# EasyEDA Pro project kuafu01_030内部老化方案_4.eprj, board PCB4 (continued)
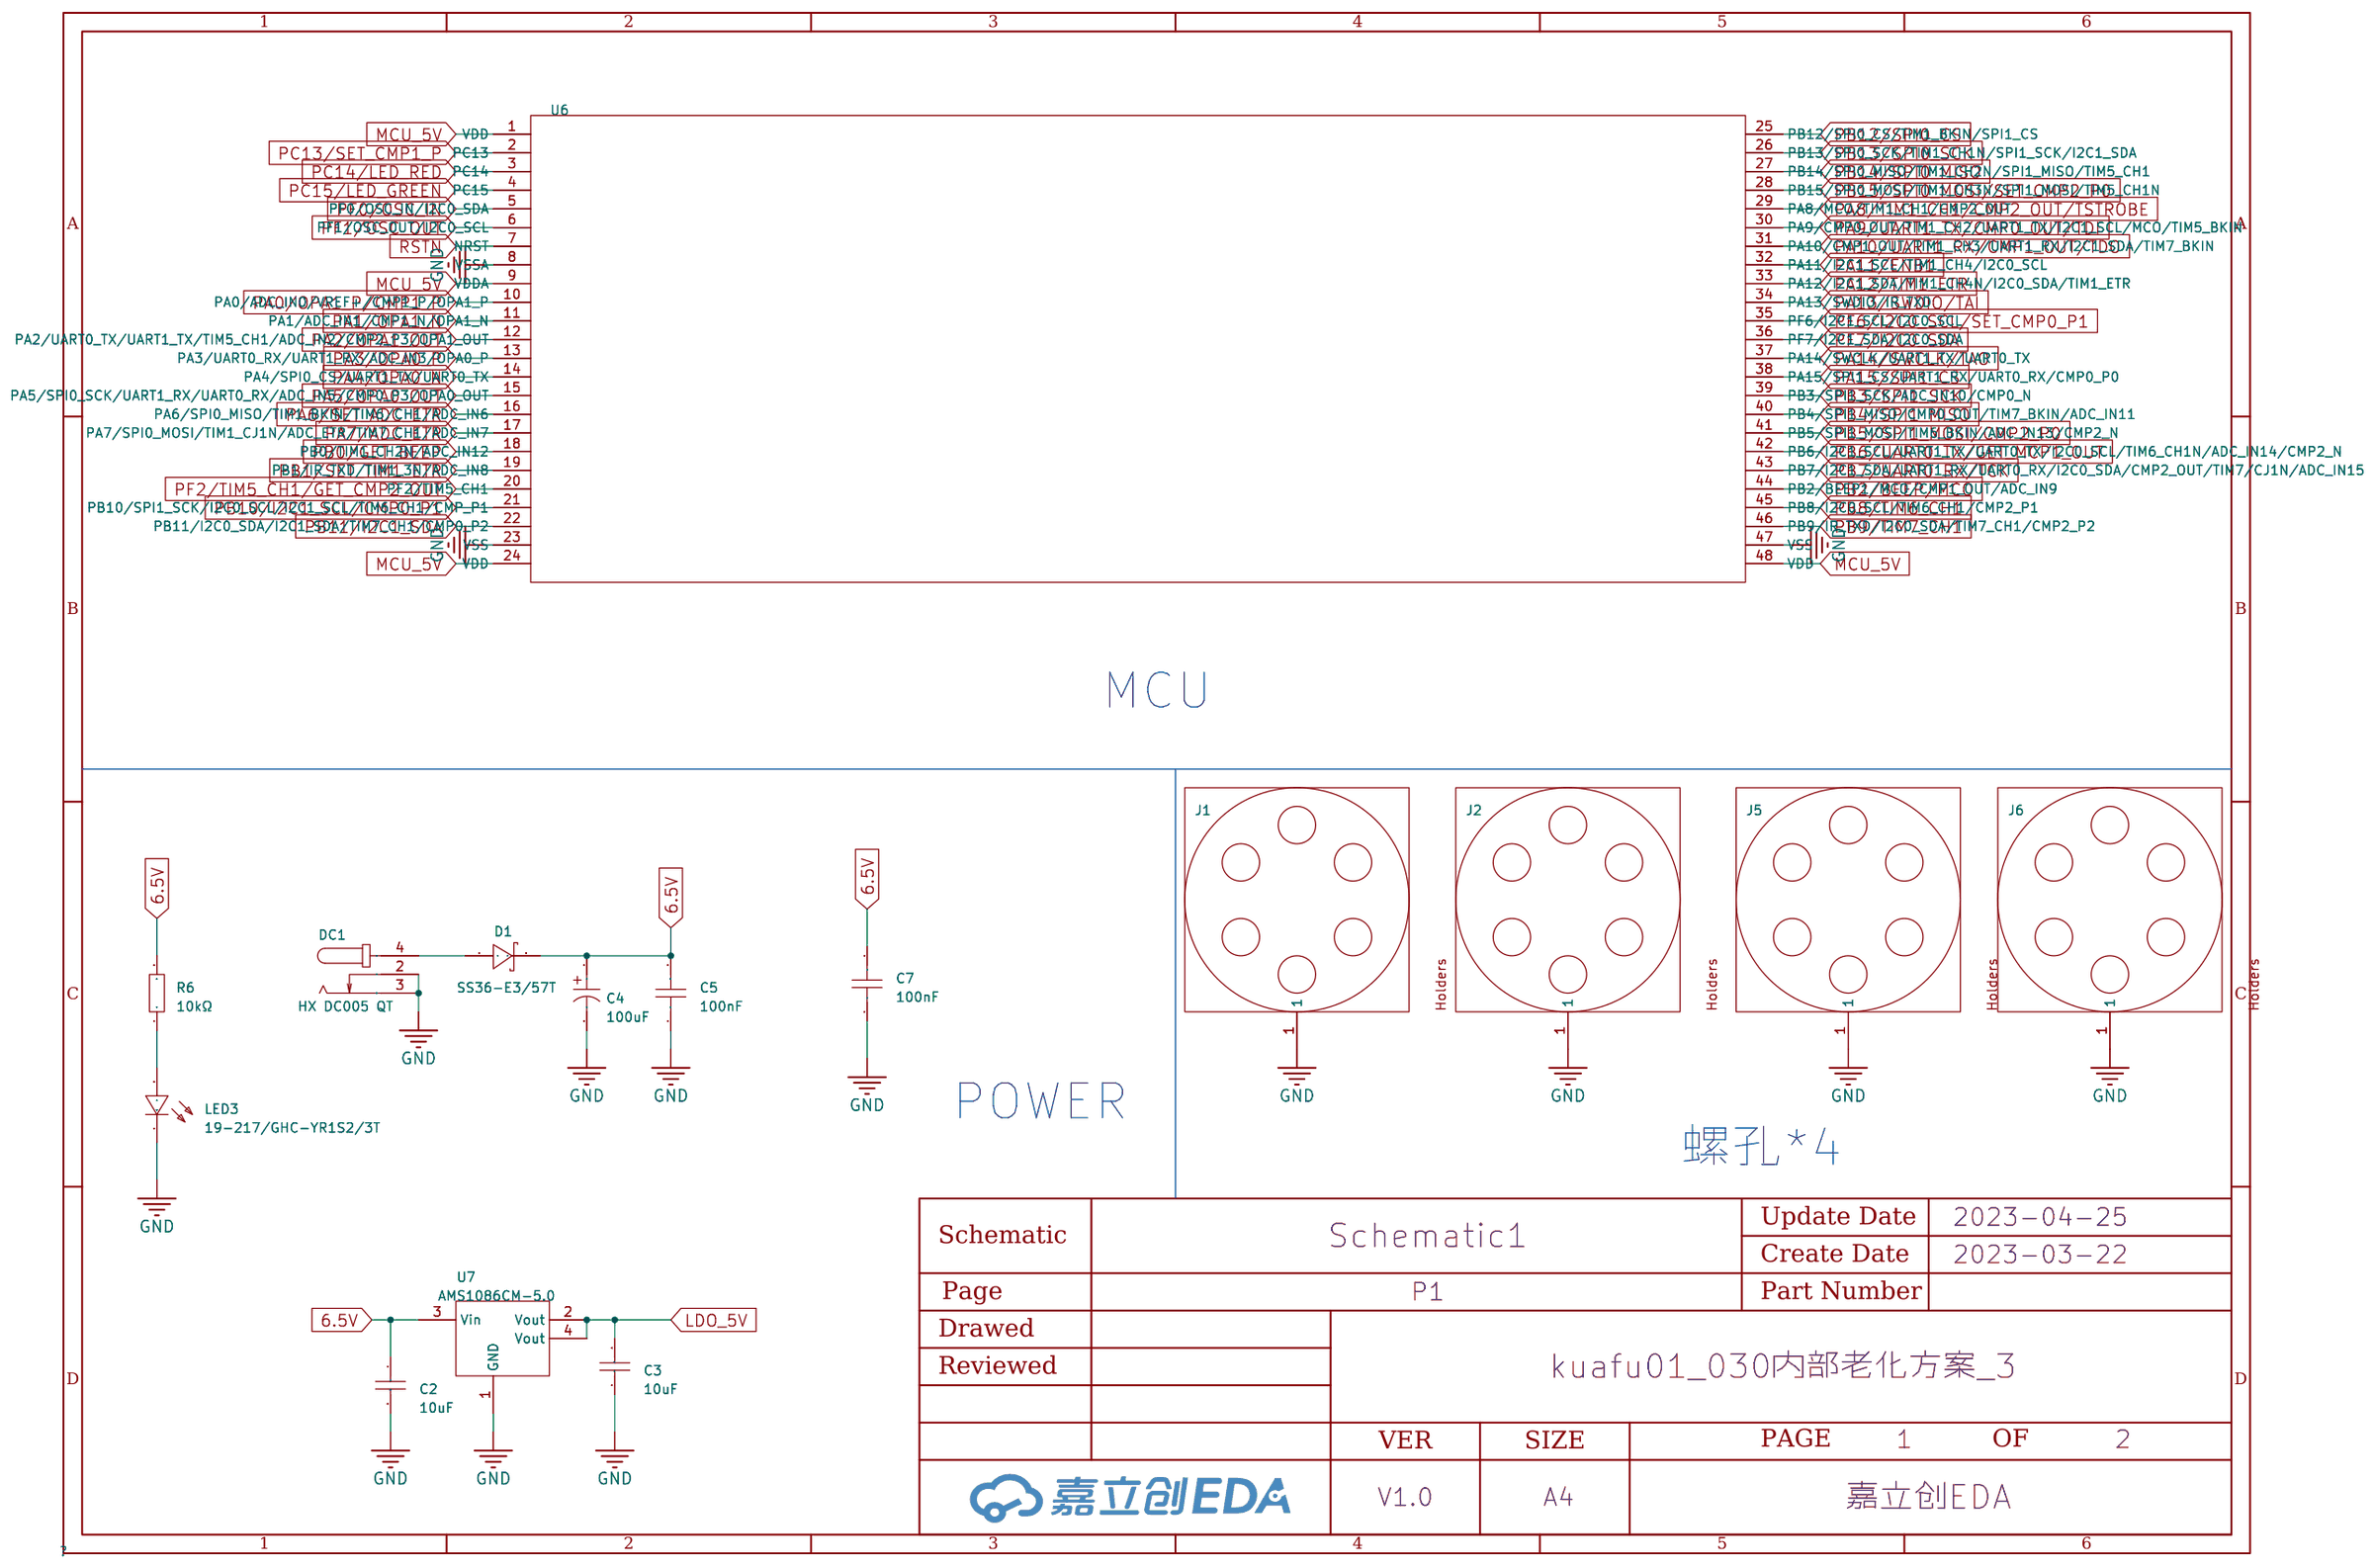
[diagram p0: P1]
## Routing (per net, layer and track width the routed paths; a pad name or vN(x,y) marks a point on that pad's centre or on a via; arc(x,y) is an arc through that point) (continued)
  vias: v1(44.45,259.08) v1(44.45,258.08) v1(44.45,257.08) v1(44.47,253.48) v1(44.47,252.48) v1(44.47,251.48) v1(44.97,140.95) v1(44.97,139.95) v1(44.97,138.95) v1(45.23,184.64) v1(45.23,183.64) v1(45.23,182.64) v1(45.2,179.05) v1(45.2,178.05) v1(45.2,177.05) v1(45.23,147.05) v1(45.23,146.05) v1(45.23,145.05) v1(45.45,259.08) v1(45.45,258.08) v1(45.45,257.08) v1(45.47,253.48) v1(45.47,252.48) v1(45.47,251.48) v1(45.48,64.75) v1(45.48,63.75) v1(45.48,62.75) v1(45.74,102.6) v1(45.74,101.6) v1(45.74,100.6) v1(45.74,70.6) v1(45.74,69.6) v1(45.74,68.6) v1(45.97,140.95) v1(45.97,139.95) v1(45.97,138.95) v1(46.23,184.64) v1(46.23,183.64) v1(46.23,182.64) v1(46.2,179.05) v1(46.2,178.05) v1(46.2,177.05) v1(46.23,147.05) v1(46.23,146.05) v1(46.23,145.05) v1(46.24,31.99) v1(46.24,30.99) v1(46.24,29.99) v1(46.45,259.08) v1(46.45,258.08) v1(46.45,257.08) v1(46.47,253.48) v1(46.47,252.48) v1(46.47,251.48) v1(46.48,64.75) v1(46.48,63.75) v1(46.48,62.75) v1(46.74,102.6) v1(46.74,101.6) v1(46.74,100.6) v1(46.74,70.6) v1(46.74,69.6) v1(46.74,68.6) v1(46.97,140.95) v1(46.97,139.95) v1(46.97,138.95) v1(47.01,222.23) v1(47.01,221.23) v1(47.01,220.23) v1(47.01,216.65) v1(47.01,215.65) v1(47.01,214.65) v1(47.23,184.64) v1(47.23,183.64) v1(47.23,182.64) v1(47.2,179.05) v1(47.2,178.05) v1(47.2,177.05) v1(47.23,147.05) v1(47.23,146.05) v1(47.23,145.05) v1(47.24,31.99) v1(47.24,30.99) v1(47.24,29.99) v1(47.48,64.75) v1(47.48,63.75) v1(47.48,62.75) v1(47.74,102.6) v1(47.74,101.6) v1(47.74,100.6) v1(47.74,70.6) v1(47.74,69.6) v1(47.74,68.6) v1(48.01,222.23) v1(48.01,221.23) v1(48.01,220.23) v1(48.01,216.65) v1(48.01,215.65) v1(48.01,214.65) v1(48.28,108.95) v1(48.28,107.95) v1(48.28,106.95) v1(48.24,31.99) v1(48.24,30.99) v1(48.24,29.99) v1(49.01,222.23) v1(49.01,221.23) v1(49.01,220.23) v1(49.01,216.65) v1(49.01,215.65) v1(49.01,214.65) v1(49.28,108.95) v1(49.28,107.95) v1(49.28,106.95) v1(49.29,147.05) v1(49.29,146.05) v1(49.29,145.05) v1(49.29,141.21) v1(49.29,140.21) v1(49.29,139.21) v1(50.28,108.95) v1(50.28,107.95) v1(50.28,106.95) v1(50.31,184.64) v1(50.31,183.64) v1(50.31,182.64) v1(50.31,179.05) v1(50.31,178.05) v1(50.31,177.05) v1(50.29,147.05) v1(50.29,146.05) v1(50.29,145.05) v1(50.29,141.21) v1(50.29,140.21) v1(50.29,139.21) v1(51.31,184.64) v1(51.31,183.64) v1(51.31,182.64) v1(51.31,179.05) v1(51.31,178.05) v1(51.31,177.05) v1(51.29,147.05) v1(51.29,146.05) v1(51.29,145.05) v1(51.29,141.21) v1(51.29,140.21) v1(51.29,139.21) v1(51.83,259.06) v1(51.83,258.06) v1(51.83,257.06) v1(51.83,253.98) v1(51.83,252.98) v1(51.83,251.98) v1(52.34,222.23) v1(52.34,221.23) v1(52.34,220.23) v1(52.34,216.65) v1(52.34,215.65) v1(52.34,214.65) v1(52.31,184.64) v1(52.31,183.64) v1(52.31,182.64) v1(52.31,179.05) v1(52.31,178.05) v1(52.31,177.05) v1(52.83,259.06) v1(52.83,258.06) v1(52.83,257.06) v1(52.83,253.98) v1(52.83,252.98) v1(52.83,251.98) v1(52.85,70.6) v1(52.85,69.6) v1(52.85,68.6) v1(53.1,102.6) v1(53.1,101.6) v1(53.1,100.6) v1(53.1,64.75) v1(53.1,63.75) v1(53.1,62.75) v1(53.34,222.23) v1(53.34,221.23) v1(53.34,220.23) v1(53.34,216.65) v1(53.34,215.65) v1(53.34,214.65) v1(53.83,259.06) v1(53.83,258.06) v1(53.83,257.06) v1(53.83,253.98) v1(53.83,252.98) v1(53.83,251.98) v1(53.85,70.6) v1(53.85,69.6) v1(53.85,68.6) v1(54.1,102.6) v1(54.1,101.6) v1(54.1,100.6) v1(54.1,64.75) v1(54.1,63.75) v1(54.1,62.75) v1(54.34,222.23) v1(54.34,221.23) v1(54.34,220.23) v1(54.34,216.65) v1(54.34,215.65) v1(54.34,214.65) v1(54.63,31.99) v1(54.63,30.99) v1(54.63,29.99) v1(54.85,70.6) v1(54.85,69.6) v1(54.85,68.6) v1(55.1,102.6) v1(55.1,101.6) v1(55.1,100.6) v1(55.1,64.75) v1(55.1,63.75) v1(55.1,62.75) v1(55.39,108.95) v1(55.39,107.95) v1(55.39,106.95) v1(55.63,31.99) v1(55.63,30.99) v1(55.63,29.99) v1(56.39,108.95) v1(56.39,107.95) v1(56.39,106.95) v1(56.63,31.99) v1(56.63,30.99) v1(56.63,29.99) v1(57.39,108.95) v1(57.39,107.95) v1(57.39,106.95) v1(63.77,31.99) v1(63.77,30.99) v1(63.77,29.99) v1(64.77,31.99) v1(64.77,30.99) v1(64.77,29.99) v1(65.77,31.99) v1(65.77,30.99) v1(65.77,29.99) v1(73.93,31.73) v1(73.93,30.73) v1(73.93,29.73) v1(74.93,31.73) v1(74.93,30.73) v1(74.93,29.73) v1(75.93,31.73) v1(75.93,30.73) v1(75.93,29.73) v1(85.11,31.99) v1(85.11,30.99) v1(85.11,29.99) v1(86.11,31.99) v1(86.11,30.99) v1(86.11,29.99) v1(87.11,31.99) v1(87.11,30.99) v1(87.11,29.99) v1(94.25,72.63) v1(94.25,71.63) v1(94.25,70.63) v1(94.25,31.73) v1(94.25,30.73) v1(94.25,29.73) v1(95.01,65.52) v1(95.01,64.52) v1(95.01,63.52) v1(95.27,140.19) v1(95.27,139.19) v1(95.27,138.19) v1(95.25,72.63) v1(95.25,71.63) v1(95.25,70.63) v1(95.25,31.73) v1(95.25,30.73) v1(95.25,29.73) v1(95.52,109.46) v1(95.52,108.46) v1(95.52,107.46) v1(96.01,65.52) v1(96.01,64.52) v1(96.01,63.52) v1(96.27,140.19) v1(96.27,139.19) v1(96.27,138.19) v1(96.25,72.63) v1(96.25,71.63) v1(96.25,70.63) v1(96.25,31.73) v1(96.25,30.73) v1(96.25,29.73) v1(96.52,109.46) v1(96.52,108.46) v1(96.52,107.46) v1(96.54,103.11) v1(96.54,102.11) v1(96.54,101.11) v1(96.79,147.56) v1(96.79,146.56) v1(96.79,145.56) v1(97.04,221.98) v1(97.04,220.98) v1(97.04,219.98) v1(97.04,216.65) v1(97.04,215.65) v1(97.04,214.65) v1(97.01,65.52) v1(97.01,64.52) v1(97.01,63.52) v1(97.27,140.19) v1(97.27,139.19) v1(97.27,138.19) v1(97.52,109.46) v1(97.52,108.46) v1(97.52,107.46) v1(97.54,103.11) v1(97.54,102.11) v1(97.54,101.11) v1(97.81,254.49) v1(97.81,253.49) v1(97.81,252.49) v1(97.79,147.56) v1(97.79,146.56) v1(97.79,145.56) v1(98.06,259.57) v1(98.06,258.57) v1(98.06,257.57) v1(98.04,221.98) v1(98.04,220.98) v1(98.04,219.98) v1(98.04,216.65) v1(98.04,215.65) v1(98.04,214.65) v1(98.54,103.11) v1(98.54,102.11) v1(98.54,101.11) v1(98.81,254.49) v1(98.81,253.49) v1(98.81,252.49) v1(98.79,147.56) v1(98.79,146.56) v1(98.79,145.56) v1(99.06,259.57) v1(99.06,258.57) v1(99.06,257.57) v1(99.04,221.98) v1(99.04,220.98) v1(99.04,219.98) v1(99.04,216.65) v1(99.04,215.65) v1(99.04,214.65) v1(99.81,254.49) v1(99.81,253.49) v1(99.81,252.49) v1(100.06,259.57) v1(100.06,258.57) v1(100.06,257.57) v1(100.09,184.64) v1(100.09,183.64) v1(100.09,182.64) v1(100.22,179.68) v1(100.22,178.68) v1(100.22,177.68) v1(101.09,184.64) v1(101.09,183.64) v1(101.09,182.64) v1(101.22,179.68) v1(101.22,178.68) v1(101.22,177.68) v1(102.09,184.64) v1(102.09,183.64) v1(102.09,182.64) v1(102.12,140.45) v1(102.12,139.45) v1(102.12,138.45) v1(102.22,179.68) v1(102.22,178.68) v1(102.22,177.68) v1(102.38,72.63) v1(102.38,71.63) v1(102.38,70.63) v1(102.38,65.52) v1(102.38,64.52) v1(102.38,63.52) v1(102.63,102.85) v1(102.63,101.85) v1(102.63,100.85) v1(102.89,254.75) v1(102.89,253.75) v1(102.89,252.75) v1(103.14,216.9) v1(103.14,215.9) v1(103.14,214.9) v1(103.12,140.45) v1(103.12,139.45) v1(103.12,138.45) v1(103.38,72.63) v1(103.38,71.63) v1(103.38,70.63) v1(103.38,65.52) v1(103.38,64.52) v1(103.38,63.52) v1(103.63,102.85) v1(103.63,101.85) v1(103.63,100.85) v1(103.9,259.32) v1(103.9,258.32) v1(103.9,257.32) v1(103.89,254.75) v1(103.89,253.75) v1(103.89,252.75) v1(103.9,221.98) v1(103.9,220.98) v1(103.9,219.98) v1(103.9,147.56) v1(103.9,146.56) v1(103.9,145.56) v1(104.14,216.9) v1(104.14,215.9) v1(104.14,214.9) v1(104.12,140.45) v1(104.12,139.45) v1(104.12,138.45) v1(104.16,109.46) v1(104.16,108.46) v1(104.16,107.46) v1(104.38,72.63) v1(104.38,71.63) v1(104.38,70.63) v1(104.38,65.52) v1(104.38,64.52) v1(104.38,63.52) v1(104.63,102.85) v1(104.63,101.85) v1(104.63,100.85) v1(104.9,259.32) v1(104.9,258.32) v1(104.9,257.32) v1(104.89,254.75) v1(104.89,253.75) v1(104.89,252.75) v1(104.9,221.98) v1(104.9,220.98) v1(104.9,219.98) v1(104.9,147.56) v1(104.9,146.56) v1(104.9,145.56) v1(105.14,216.9) v1(105.14,215.9) v1(105.14,214.9) v1(105.16,109.46) v1(105.16,108.46) v1(105.16,107.46) v1(105.43,184.64) v1(105.43,183.64) v1(105.43,182.64) v1(105.43,179.68) v1(105.43,178.68) v1(105.43,177.68) v1(105.9,259.32) v1(105.9,258.32) v1(105.9,257.32) v1(105.9,221.98) v1(105.9,220.98) v1(105.9,219.98) v1(105.9,147.56) v1(105.9,146.56) v1(105.9,145.56) v1(106.16,109.46) v1(106.16,108.46) v1(106.16,107.46) v1(106.43,184.64) v1(106.43,183.64) v1(106.43,182.64) v1(106.43,179.68) v1(106.43,178.68) v1(106.43,177.68) v1(107.2,31.23) v1(107.2,30.23) v1(107.2,29.23) v1(107.43,184.64) v1(107.43,183.64) v1(107.43,182.64) v1(107.43,179.68) v1(107.43,178.68) v1(107.43,177.68) v1(108.2,31.23) v1(108.2,30.23) v1(108.2,29.23) v1(109.2,31.23) v1(109.2,30.23) v1(109.2,29.23) v1(115.59,31.23) v1(115.59,30.23) v1(115.59,29.23) v1(116.59,31.23) v1(116.59,30.23) v1(116.59,29.23) v1(117.59,31.23) v1(117.59,30.23) v1(117.59,29.23) v1(134.64,30.72) v1(134.64,29.72) v1(134.64,28.72) v1(135.64,30.72) v1(135.64,29.72) v1(135.64,28.72) v1(136.64,30.72) v1(136.64,29.72) v1(136.64,28.72) v1(140.73,30.72) v1(140.73,29.72) v1(140.73,28.72) v1(141.73,30.72) v1(141.73,29.72) v1(141.73,28.72) v1(142.73,30.72) v1(142.73,29.72) v1(142.73,28.72) v1(145.05,71.61) v1(145.05,70.61) v1(145.05,69.61) v1(145.56,146.54) v1(145.56,145.54) v1(145.56,144.54) v1(145.81,109.46) v1(145.81,108.46) v1(145.81,107.46) v1(146.05,71.61) v1(146.05,70.61) v1(146.05,69.61) v1(146.57,223.25) v1(146.57,222.25) v1(146.57,221.25) v1(146.56,146.54) v1(146.56,145.54) v1(146.56,144.54) v1(146.81,109.46) v1(146.81,108.46) v1(146.81,107.46) v1(146.83,103.62) v1(146.83,102.62) v1(146.83,101.62) v1(147.08,184.9) v1(147.08,183.9) v1(147.08,182.9) v1(147.07,179.82) v1(147.07,178.82) v1(147.07,177.82) v1(147.05,71.61) v1(147.05,70.61) v1(147.05,69.61) v1(147.08,65.52) v1(147.08,64.52) v1(147.08,63.52) v1(147.34,30.72) v1(147.34,29.72) v1(147.34,28.72) v1(147.57,223.25) v1(147.57,222.25) v1(147.57,221.25) v1(147.56,146.54) v1(147.56,145.54) v1(147.56,144.54) v1(147.59,140.7) v1(147.59,139.7) v1(147.59,138.7) v1(147.81,109.46) v1(147.81,108.46) v1(147.81,107.46) v1(147.83,103.62) v1(147.83,102.62) v1(147.83,101.62) v1(148.08,184.9) v1(148.08,183.9) v1(148.08,182.9) v1(148.07,179.82) v1(148.07,178.82) v1(148.07,177.82) v1(148.08,65.52) v1(148.08,64.52) v1(148.08,63.52) v1(148.35,217.15) v1(148.35,216.15) v1(148.35,215.15) v1(148.34,30.72) v1(148.34,29.72) v1(148.34,28.72) v1(148.57,223.25) v1(148.57,222.25) v1(148.57,221.25) v1(148.61,254.49) v1(148.61,253.49) v1(148.61,252.49) v1(148.59,140.7) v1(148.59,139.7) v1(148.59,138.7) v1(148.83,103.62) v1(148.83,102.62) v1(148.83,101.62) v1(149.08,184.9) v1(149.08,183.9) v1(149.08,182.9) v1(149.07,179.82) v1(149.07,178.82) v1(149.07,177.82) v1(149.08,65.52) v1(149.08,64.52) v1(149.08,63.52) v1(149.37,260.59) v1(149.37,259.59) v1(149.37,258.59) v1(149.35,217.15) v1(149.35,216.15) v1(149.35,215.15) v1(149.34,30.72) v1(149.34,29.72) v1(149.34,28.72) v1(149.61,254.49) v1(149.61,253.49) v1(149.61,252.49) v1(149.59,140.7) v1(149.59,139.7) v1(149.59,138.7) v1(150.37,260.59) v1(150.37,259.59) v1(150.37,258.59) v1(150.35,217.15) v1(150.35,216.15) v1(150.35,215.15) v1(150.61,254.49) v1(150.61,253.49) v1(150.61,252.49) v1(150.89,146.54) v1(150.89,145.54) v1(150.89,144.54) v1(151.37,260.59) v1(151.37,259.59) v1(151.37,258.59) v1(151.4,71.61) v1(151.4,70.61) v1(151.4,69.61) v1(151.65,109.46) v1(151.65,108.46) v1(151.65,107.46) v1(151.91,184.9) v1(151.91,183.9) v1(151.91,182.9) v1(151.91,179.82) v1(151.91,178.82) v1(151.91,177.82) v1(151.89,146.54) v1(151.89,145.54) v1(151.89,144.54) v1(152.4,71.61) v1(152.4,70.61) v1(152.4,69.61) v1(152.65,109.46) v1(152.65,108.46) v1(152.65,107.46) v1(152.91,184.9) v1(152.91,183.9) v1(152.91,182.9) v1(152.91,179.82) v1(152.91,178.82) v1(152.91,177.82) v1(152.89,146.54) v1(152.89,145.54) v1(152.89,144.54) v1(152.92,103.62) v1(152.92,102.62) v1(152.92,101.62) v1(153.18,223.5) v1(153.18,222.5) v1(153.18,221.5) v1(153.43,140.7) v1(153.43,139.7) v1(153.43,138.7) v1(153.4,71.61) v1(153.4,70.61) v1(153.4,69.61) v1(153.43,65.26) v1(153.43,64.26) v1(153.43,63.26) v1(153.65,109.46) v1(153.65,108.46) v1(153.65,107.46) v1(153.94,254.49) v1(153.94,253.49) v1(153.94,252.49) v1(153.91,184.9) v1(153.91,183.9) v1(153.91,182.9) v1(153.91,179.82) v1(153.91,178.82) v1(153.91,177.82) v1(153.92,103.62) v1(153.92,102.62) v1(153.92,101.62) v1(154.18,223.5) v1(154.18,222.5) v1(154.18,221.5) v1(154.43,140.7) v1(154.43,139.7) v1(154.43,138.7) v1(154.43,65.26) v1(154.43,64.26) v1(154.43,63.26) v1(154.94,254.49) v1(154.94,253.49) v1(154.94,252.49) v1(154.96,217.15) v1(154.96,216.15) v1(154.96,215.15) v1(154.92,103.62) v1(154.92,102.62) v1(154.92,101.62) v1(155.18,223.5) v1(155.18,222.5) v1(155.18,221.5) v1(155.46,260.59) v1(155.46,259.59) v1(155.46,258.59) v1(155.43,140.7) v1(155.43,139.7) v1(155.43,138.7) v1(155.43,65.26) v1(155.43,64.26) v1(155.43,63.26) v1(155.94,254.49) v1(155.94,253.49) v1(155.94,252.49) v1(155.96,217.15) v1(155.96,216.15) v1(155.96,215.15) v1(155.97,146.54) v1(155.97,145.54) v1(155.97,144.54) v1(156.46,260.59) v1(156.46,259.59) v1(156.46,258.59) v1(156.96,217.15) v1(156.96,216.15) v1(156.96,215.15) v1(156.97,146.54) v1(156.97,145.54) v1(156.97,144.54) v1(156.99,184.9) v1(156.99,183.9) v1(156.99,182.9) v1(157.46,260.59) v1(157.46,259.59) v1(157.46,258.59) v1(157.5,109.46) v1(157.5,108.46) v1(157.5,107.46) v1(157.5,71.61) v1(157.5,70.61) v1(157.5,69.61) v1(157.97,146.54) v1(157.97,145.54) v1(157.97,144.54) v1(157.99,184.9) v1(157.99,183.9) v1(157.99,182.9) v1(158.5,109.46) v1(158.5,108.46) v1(158.5,107.46) v1(158.5,71.61) v1(158.5,70.61) v1(158.5,69.61) v1(159.02,223.5) v1(159.02,222.5) v1(159.02,221.5) v1(158.99,184.9) v1(158.99,183.9) v1(158.99,182.9) v1(159.5,109.46) v1(159.5,108.46) v1(159.5,107.46) v1(159.5,71.61) v1(159.5,70.61) v1(159.5,69.61) v1(160.02,223.5) v1(160.02,222.5) v1(160.02,221.5) v1(161.02,223.5) v1(161.02,222.5) v1(161.02,221.5) v1(196.61,103.36) v1(196.61,102.36) v1(196.61,101.36) v1(196.61,65.01) v1(196.61,64.01) v1(196.61,63.01) v1(197.37,71.1) v1(197.37,70.1) v1(197.37,69.1) v1(197.63,221.22) v1(197.63,220.22) v1(197.63,219.22) v1(197.63,215.88) v1(197.63,214.88) v1(197.63,213.88) v1(197.61,103.36) v1(197.61,102.36) v1(197.61,101.36) v1(197.61,65.01) v1(197.61,64.01) v1(197.61,63.01) v1(198.14,140.7) v1(198.14,139.7) v1(198.14,138.7) v1(198.37,71.1) v1(198.37,70.1) v1(198.37,69.1) v1(198.39,109.71) v1(198.39,108.71) v1(198.39,107.71) v1(198.63,221.22) v1(198.63,220.22) v1(198.63,219.22) v1(198.63,215.88) v1(198.63,214.88) v1(198.63,213.88) v1(198.61,103.36) v1(198.61,102.36) v1(198.61,101.36) v1(198.61,65.01) v1(198.61,64.01) v1(198.61,63.01) v1(198.9,184.64) v1(198.9,183.64) v1(198.9,182.64) v1(198.93,178.99) v1(198.93,177.99) v1(198.93,176.99) v1(198.9,146.54) v1(198.9,145.54) v1(198.9,144.54) v1(199.14,140.7) v1(199.14,139.7) v1(199.14,138.7) v1(199.37,71.1) v1(199.37,70.1) v1(199.37,69.1) v1(199.39,109.71) v1(199.39,108.71) v1(199.39,107.71) v1(199.63,221.22) v1(199.63,220.22) v1(199.63,219.22) v1(199.63,215.88) v1(199.63,214.88) v1(199.63,213.88) v1(199.9,184.64) v1(199.9,183.64) v1(199.9,182.64) v1(199.93,178.99) v1(199.93,177.99) v1(199.93,176.99) v1(199.9,146.54) v1(199.9,145.54) v1(199.9,144.54) v1(200.14,140.7) v1(200.14,139.7) v1(200.14,138.7) v1(200.39,109.71) v1(200.39,108.71) v1(200.39,107.71) v1(200.93,260.08) v1(200.93,259.08) v1(200.93,258.08) v1(200.93,255.25) v1(200.93,254.25) v1(200.93,253.25) v1(200.9,184.64) v1(200.9,183.64) v1(200.9,182.64) v1(200.93,178.99) v1(200.93,177.99) v1(200.93,176.99) v1(200.9,146.54) v1(200.9,145.54) v1(200.9,144.54) v1(201.93,260.08) v1(201.93,259.08) v1(201.93,258.08) v1(201.93,255.25) v1(201.93,254.25) v1(201.93,253.25) v1(202.93,260.08) v1(202.93,259.08) v1(202.93,258.08) v1(202.93,255.25) v1(202.93,254.25) v1(202.93,253.25) v1(203.47,71.1) v1(203.47,70.1) v1(203.47,69.1) v1(203.72,216.39) v1(203.72,215.39) v1(203.72,214.39) v1(203.98,221.22) v1(203.98,220.22) v1(203.98,219.22) v1(203.98,103.36) v1(203.98,102.36) v1(203.98,101.36) v1(203.98,65.01) v1(203.98,64.01) v1(203.98,63.01) v1(204.47,71.1) v1(204.47,70.1) v1(204.47,69.1) v1(204.72,216.39) v1(204.72,215.39) v1(204.72,214.39) v1(204.74,184.64) v1(204.74,183.64) v1(204.74,182.64) v1(204.74,178.99) v1(204.74,177.99) v1(204.74,176.99) v1(204.74,140.45) v1(204.74,139.45) v1(204.74,138.45) v1(204.98,221.22) v1(204.98,220.22) v1(204.98,219.22) v1(204.98,103.36) v1(204.98,102.36) v1(204.98,101.36) v1(204.98,65.01) v1(204.98,64.01) v1(204.98,63.01) v1(205.25,146.29) v1(205.25,145.29) v1(205.25,144.29) v1(205.25,109.71) v1(205.25,108.71) v1(205.25,107.71) v1(205.47,71.1) v1(205.47,70.1) v1(205.47,69.1) v1(205.76,260.59) v1(205.76,259.59) v1(205.76,258.59) v1(205.76,255.25) v1(205.76,254.25) v1(205.76,253.25) v1(205.72,216.39) v1(205.72,215.39) v1(205.72,214.39) v1(205.74,184.64) v1(205.74,183.64) v1(205.74,182.64) v1(205.74,178.99) v1(205.74,177.99) v1(205.74,176.99) v1(205.74,140.45) v1(205.74,139.45) v1(205.74,138.45) v1(205.98,221.22) v1(205.98,220.22) v1(205.98,219.22) v1(205.98,103.36) v1(205.98,102.36) v1(205.98,101.36) v1(205.98,65.01) v1(205.98,64.01) v1(205.98,63.01) v1(206.25,146.29) v1(206.25,145.29) v1(206.25,144.29) v1(206.25,109.71) v1(206.25,108.71) v1(206.25,107.71) v1(206.76,260.59) v1(206.76,259.59) v1(206.76,258.59) v1(206.76,255.25) v1(206.76,254.25) v1(206.76,253.25) v1(206.74,184.64) v1(206.74,183.64) v1(206.74,182.64) v1(206.74,178.99) v1(206.74,177.99) v1(206.74,176.99) v1(206.74,140.45) v1(206.74,139.45) v1(206.74,138.45) v1(207.25,146.29) v1(207.25,145.29) v1(207.25,144.29) v1(207.25,109.71) v1(207.25,108.71) v1(207.25,107.71) v1(207.76,260.59) v1(207.76,259.59) v1(207.76,258.59) v1(207.76,255.25) v1(207.76,254.25) v1(207.76,253.25) v1(245.38,221.22) v1(245.38,220.22) v1(245.38,219.22) v1(245.38,146.54) v1(245.38,145.54) v1(245.38,144.54) v1(245.63,184.9) v1(245.63,183.9) v1(245.63,182.9) v1(245.63,108.95) v1(245.63,107.95) v1(245.63,106.95) v1(245.7,103.11) v1(245.7,102.11) v1(245.7,101.11) v1(245.89,140.45) v1(245.89,139.45) v1(245.89,138.45) v1(246.14,216.14) v1(246.14,215.14) v1(246.14,214.14) v1(246.38,221.22) v1(246.38,220.22) v1(246.38,219.22) v1(246.38,146.54) v1(246.38,145.54) v1(246.38,144.54) v1(246.4,71.1) v1(246.4,70.1) v1(246.4,69.1) v1(246.4,65.52) v1(246.4,64.52) v1(246.4,63.52) v1(246.63,184.9) v1(246.63,183.9) v1(246.63,182.9) v1(246.63,108.95) v1(246.63,107.95) v1(246.63,106.95) v1(246.7,103.11) v1(246.7,102.11) v1(246.7,101.11) v1(246.89,140.45) v1(246.89,139.45) v1(246.89,138.45) v1(247.14,216.14) v1(247.14,215.14) v1(247.14,214.14) v1(247.24,179.05) v1(247.24,178.05) v1(247.24,177.05) v1(247.38,221.22) v1(247.38,220.22) v1(247.38,219.22) v1(247.38,146.54) v1(247.38,145.54) v1(247.38,144.54) v1(247.4,71.1) v1(247.4,70.1) v1(247.4,69.1) v1(247.4,65.52) v1(247.4,64.52) v1(247.4,63.52) v1(247.63,184.9) v1(247.63,183.9) v1(247.63,182.9) v1(247.63,108.95) v1(247.63,107.95) v1(247.63,106.95) v1(247.7,103.11) v1(247.7,102.11) v1(247.7,101.11) v1(247.89,140.45) v1(247.89,139.45) v1(247.89,138.45) v1(248.14,216.14) v1(248.14,215.14) v1(248.14,214.14) v1(248.24,179.05) v1(248.24,178.05) v1(248.24,177.05) v1(248.4,71.1) v1(248.4,70.1) v1(248.4,69.1) v1(248.4,65.52) v1(248.4,64.52) v1(248.4,63.52) v1(249.24,179.05) v1(249.24,178.05) v1(249.24,177.05) v1(250.71,216.14) v1(250.71,215.14) v1(250.71,214.14) v1(250.71,140.45) v1(250.71,139.45) v1(250.71,138.45) v1(250.97,221.47) v1(250.97,220.47) v1(250.97,219.47) v1(250.97,184.9) v1(250.97,183.9) v1(250.97,182.9) v1(250.97,179.05) v1(250.97,178.05) v1(250.97,177.05) v1(250.97,146.54) v1(250.97,145.54) v1(250.97,144.54) v1(250.97,71.1) v1(250.97,70.1) v1(250.97,69.1) v1(250.97,65.52) v1(250.97,64.52) v1(250.97,63.52) v1(251.71,216.14) v1(251.71,215.14) v1(251.71,214.14) v1(251.71,140.45) v1(251.71,139.45) v1(251.71,138.45) v1(251.73,108.95) v1(251.73,107.95) v1(251.73,106.95) v1(251.73,103.11) v1(251.73,102.11) v1(251.73,101.11) v1(251.97,221.47) v1(251.97,220.47) v1(251.97,219.47) v1(251.97,184.9) v1(251.97,183.9) v1(251.97,182.9) v1(251.97,179.05) v1(251.97,178.05) v1(251.97,177.05) v1(251.97,146.54) v1(251.97,145.54) v1(251.97,144.54) v1(251.97,71.1) v1(251.97,70.1) v1(251.97,69.1) v1(251.97,65.52) v1(251.97,64.52) v1(251.97,63.52) v1(252.71,216.14) v1(252.71,215.14) v1(252.71,214.14) v1(252.71,140.45) v1(252.71,139.45) v1(252.71,138.45) v1(252.73,108.95) v1(252.73,107.95) v1(252.73,106.95) v1(252.73,103.11) v1(252.73,102.11) v1(252.73,101.11) v1(252.97,221.47) v1(252.97,220.47) v1(252.97,219.47) v1(252.97,184.9) v1(252.97,183.9) v1(252.97,182.9) v1(252.97,179.05) v1(252.97,178.05) v1(252.97,177.05) v1(252.97,146.54) v1(252.97,145.54) v1(252.97,144.54) v1(252.97,71.1) v1(252.97,70.1) v1(252.97,69.1) v1(252.97,65.52) v1(252.97,64.52) v1(252.97,63.52) v1(253.73,108.95) v1(253.73,107.95) v1(253.73,106.95) v1(253.73,103.11) v1(253.73,102.11) v1(253.73,101.11)
